# Altium schematic sheet 0020_Processor - POWER .SchDoc
size A2
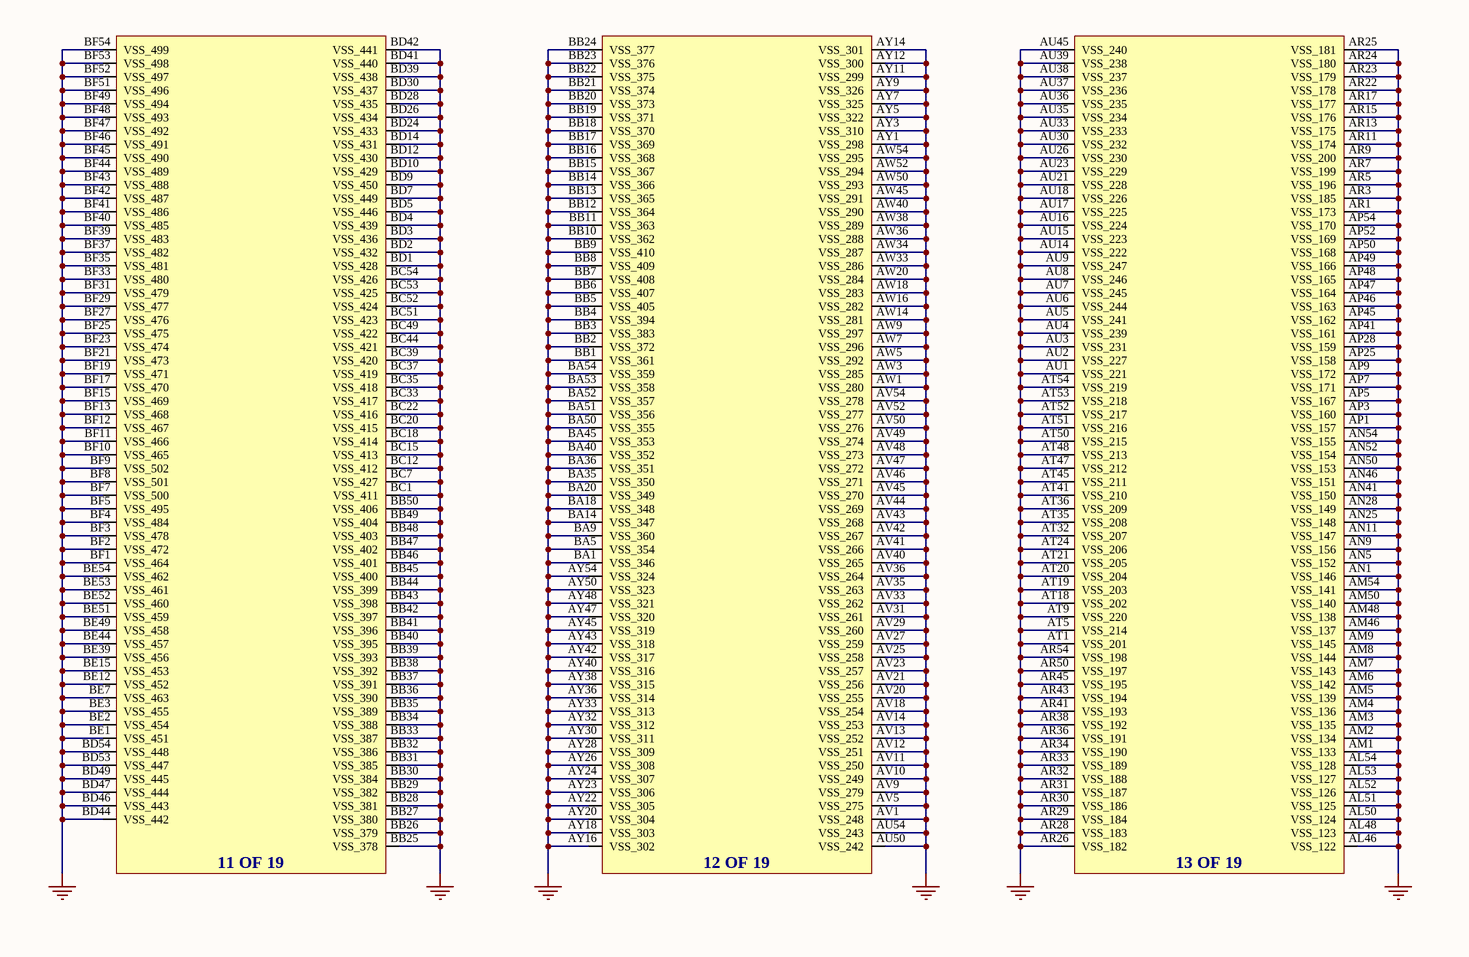
[diagram p0: 0020_Processor - POWER .SchDoc, left]
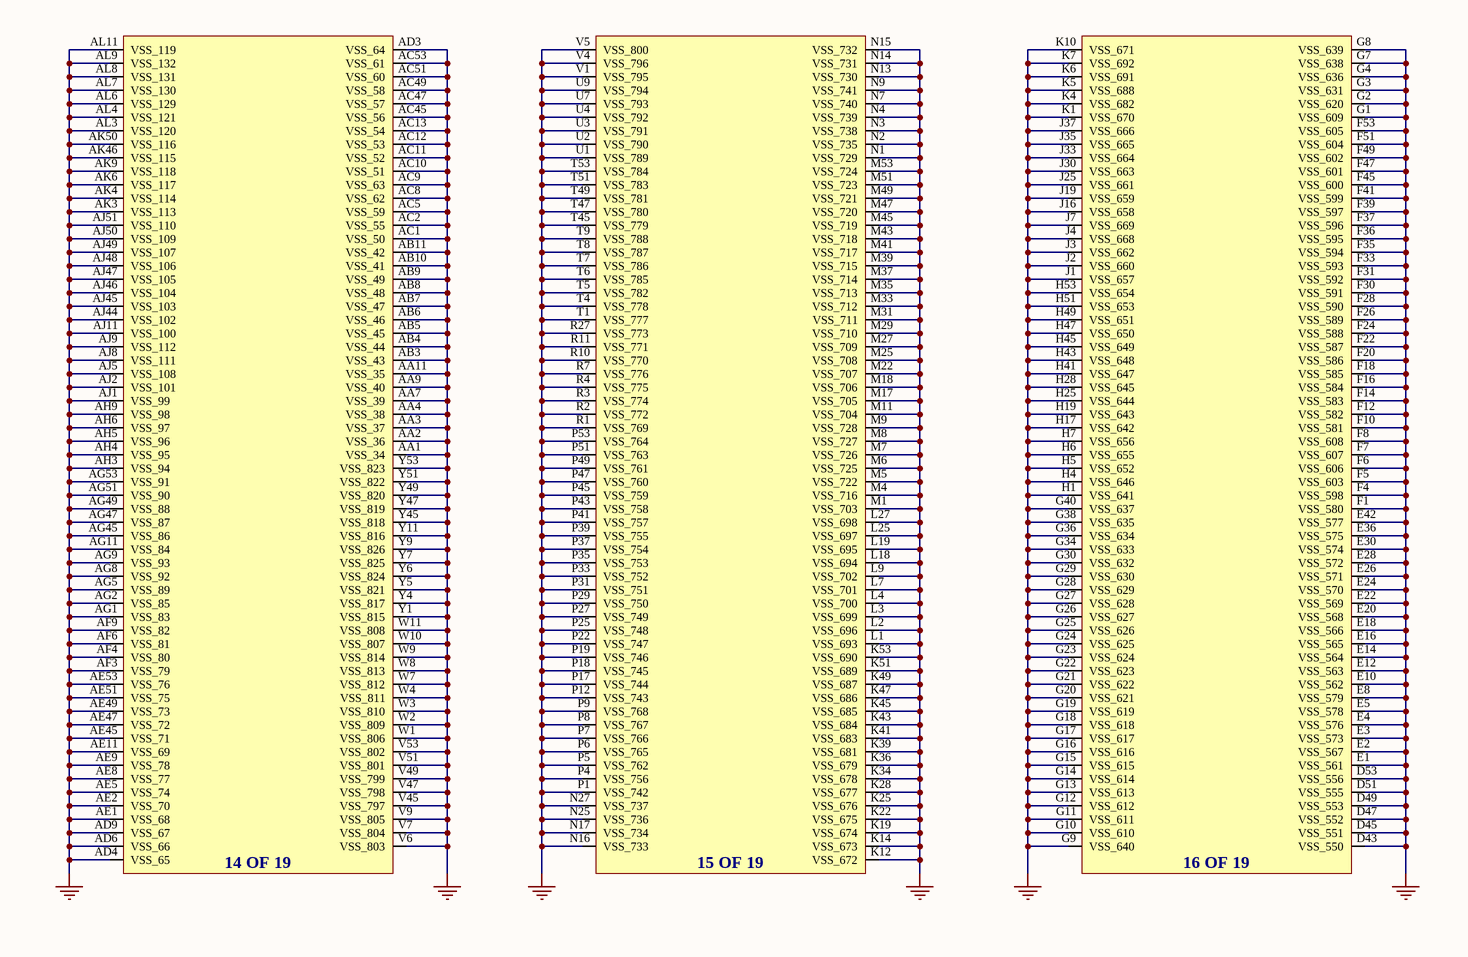
[diagram p1: 0020_Processor - POWER .SchDoc, right]

## Parts
U1401  C_RPL_HX_EXT  (value not drawn)  (parts K,L,M,N,O,P of 19)

## Nets
GND: U1401.AA1(VSS_34) U1401.AA2(VSS_36) U1401.AA3(VSS_37) U1401.AA4(VSS_38) U1401.AA7(VSS_39) U1401.AA9(VSS_40) U1401.AA11(VSS_35) U1401.AB3(VSS_43) U1401.AB4(VSS_44) U1401.AB5(VSS_45) U1401.AB6(VSS_46) U1401.AB7(VSS_47) U1401.AB8(VSS_48) U1401.AB9(VSS_49) U1401.AB10(VSS_41) U1401.AB11(VSS_42) U1401.AC1(VSS_50) U1401.AC2(VSS_55) U1401.AC5(VSS_59) U1401.AC8(VSS_62) U1401.AC9(VSS_63) U1401.AC10(VSS_51) U1401.AC11(VSS_52) U1401.AC12(VSS_53) U1401.AC13(VSS_54) U1401.AC45(VSS_56) U1401.AC47(VSS_57) U1401.AC49(VSS_58) U1401.AC51(VSS_60) U1401.AC53(VSS_61) U1401.AD3(VSS_64) U1401.AD4(VSS_65) U1401.AD6(VSS_66) U1401.AD9(VSS_67) U1401.AE1(VSS_68) U1401.AE2(VSS_70) U1401.AE5(VSS_74) U1401.AE8(VSS_77) U1401.AE9(VSS_78) U1401.AE11(VSS_69) U1401.AE45(VSS_71) U1401.AE47(VSS_72) U1401.AE49(VSS_73) U1401.AE51(VSS_75) U1401.AE53(VSS_76) U1401.AF3(VSS_79) U1401.AF4(VSS_80) U1401.AF6(VSS_81) U1401.AF9(VSS_82) U1401.AG1(VSS_83) U1401.AG2(VSS_85) U1401.AG5(VSS_89) U1401.AG8(VSS_92) U1401.AG9(VSS_93) U1401.AG11(VSS_84) U1401.AG45(VSS_86) U1401.AG47(VSS_87) U1401.AG49(VSS_88) U1401.AG51(VSS_90) U1401.AG53(VSS_91) U1401.AH3(VSS_94) U1401.AH4(VSS_95) U1401.AH5(VSS_96) U1401.AH6(VSS_97) U1401.AH9(VSS_98) U1401.AJ1(VSS_99) U1401.AJ2(VSS_101) U1401.AJ5(VSS_108) U1401.AJ8(VSS_111) U1401.AJ9(VSS_112) U1401.AJ11(VSS_100) U1401.AJ44(VSS_102) U1401.AJ45(VSS_103) U1401.AJ46(VSS_104) U1401.AJ47(VSS_105) U1401.AJ48(VSS_106) U1401.AJ49(VSS_107) U1401.AJ50(VSS_109) U1401.AJ51(VSS_110) U1401.AK3(VSS_113) U1401.AK4(VSS_114) U1401.AK6(VSS_117) U1401.AK9(VSS_118) U1401.AK46(VSS_115) U1401.AK50(VSS_116) U1401.AL3(VSS_120) U1401.AL4(VSS_121) U1401.AL6(VSS_129) U1401.AL7(VSS_130) U1401.AL8(VSS_131) U1401.AL9(VSS_132) U1401.AL11(VSS_119) U1401.AL46(VSS_122) U1401.AL48(VSS_123) U1401.AL50(VSS_124) U1401.AL51(VSS_125) U1401.AL52(VSS_126) U1401.AL53(VSS_127) U1401.AL54(VSS_128) U1401.AM1(VSS_133) U1401.AM2(VSS_134) U1401.AM3(VSS_135) U1401.AM4(VSS_136) U1401.AM5(VSS_139) U1401.AM6(VSS_142) U1401.AM7(VSS_143) U1401.AM8(VSS_144) U1401.AM9(VSS_145) U1401.AM46(VSS_137) U1401.AM48(VSS_138) U1401.AM50(VSS_140) U1401.AM54(VSS_141) U1401.AN1(VSS_146) U1401.AN5(VSS_152) U1401.AN9(VSS_156) U1401.AN11(VSS_147) U1401.AN25(VSS_148) U1401.AN28(VSS_149) U1401.AN41(VSS_150) U1401.AN46(VSS_151) U1401.AN50(VSS_153) U1401.AN52(VSS_154) U1401.AN54(VSS_155) U1401.AP1(VSS_157) U1401.AP3(VSS_160) U1401.AP5(VSS_167) U1401.AP7(VSS_171) U1401.AP9(VSS_172) U1401.AP25(VSS_158) U1401.AP28(VSS_159) U1401.AP41(VSS_161) U1401.AP45(VSS_162) U1401.AP46(VSS_163) U1401.AP47(VSS_164) U1401.AP48(VSS_165) U1401.AP49(VSS_166) U1401.AP50(VSS_168) U1401.AP52(VSS_169) U1401.AP54(VSS_170) U1401.AR1(VSS_173) U1401.AR3(VSS_185) U1401.AR5(VSS_196) U1401.AR7(VSS_199) U1401.AR9(VSS_200) U1401.AR11(VSS_174) U1401.AR13(VSS_175) U1401.AR15(VSS_176) U1401.AR17(VSS_177) U1401.AR22(VSS_178) U1401.AR23(VSS_179) U1401.AR24(VSS_180) U1401.AR25(VSS_181) U1401.AR26(VSS_182) U1401.AR28(VSS_183) U1401.AR29(VSS_184) U1401.AR30(VSS_186) U1401.AR31(VSS_187) U1401.AR32(VSS_188) U1401.AR33(VSS_189) U1401.AR34(VSS_190) U1401.AR36(VSS_191) U1401.AR38(VSS_192) U1401.AR41(VSS_193) U1401.AR43(VSS_194) U1401.AR45(VSS_195) U1401.AR50(VSS_197) U1401.AR54(VSS_198) U1401.AT1(VSS_201) U1401.AT5(VSS_214) U1401.AT9(VSS_220) U1401.AT18(VSS_202) U1401.AT19(VSS_203) U1401.AT20(VSS_204) U1401.AT21(VSS_205) U1401.AT24(VSS_206) U1401.AT32(VSS_207) U1401.AT35(VSS_208) U1401.AT36(VSS_209) U1401.AT41(VSS_210) U1401.AT45(VSS_211) U1401.AT47(VSS_212) U1401.AT48(VSS_213) U1401.AT50(VSS_215) U1401.AT51(VSS_216) U1401.AT52(VSS_217) U1401.AT53(VSS_218) U1401.AT54(VSS_219) U1401.AU1(VSS_221) U1401.AU2(VSS_227) U1401.AU3(VSS_231) U1401.AU4(VSS_239) U1401.AU5(VSS_241) U1401.AU6(VSS_244) U1401.AU7(VSS_245) U1401.AU8(VSS_246) U1401.AU9(VSS_247) U1401.AU14(VSS_222) U1401.AU15(VSS_223) U1401.AU16(VSS_224) U1401.AU17(VSS_225) U1401.AU18(VSS_226) U1401.AU21(VSS_228) U1401.AU23(VSS_229) U1401.AU26(VSS_230) U1401.AU30(VSS_232) U1401.AU33(VSS_233) U1401.AU35(VSS_234) U1401.AU36(VSS_235) U1401.AU37(VSS_236) U1401.AU38(VSS_237) U1401.AU39(VSS_238) U1401.AU45(VSS_240) U1401.AU50(VSS_242) U1401.AU54(VSS_243) U1401.AV1(VSS_248) U1401.AV5(VSS_275) U1401.AV9(VSS_279) U1401.AV10(VSS_249) U1401.AV11(VSS_250) U1401.AV12(VSS_251) U1401.AV13(VSS_252) U1401.AV14(VSS_253) U1401.AV18(VSS_254) U1401.AV20(VSS_255) U1401.AV21(VSS_256) U1401.AV23(VSS_257) U1401.AV25(VSS_258) U1401.AV27(VSS_259) U1401.AV29(VSS_260) U1401.AV31(VSS_261) U1401.AV33(VSS_262) U1401.AV35(VSS_263) U1401.AV36(VSS_264) U1401.AV40(VSS_265) U1401.AV41(VSS_266) U1401.AV42(VSS_267) U1401.AV43(VSS_268) U1401.AV44(VSS_269) U1401.AV45(VSS_270) U1401.AV46(VSS_271) U1401.AV47(VSS_272) U1401.AV48(VSS_273) U1401.AV49(VSS_274) U1401.AV50(VSS_276) U1401.AV52(VSS_277) U1401.AV54(VSS_278) U1401.AW1(VSS_280) U1401.AW3(VSS_285) U1401.AW5(VSS_292) U1401.AW7(VSS_296) U1401.AW9(VSS_297) U1401.AW14(VSS_281) U1401.AW16(VSS_282) U1401.AW18(VSS_283) U1401.AW20(VSS_284) U1401.AW33(VSS_286) U1401.AW34(VSS_287) U1401.AW36(VSS_288) U1401.AW38(VSS_289) U1401.AW40(VSS_290) U1401.AW45(VSS_291) U1401.AW50(VSS_293) U1401.AW52(VSS_294) U1401.AW54(VSS_295) U1401.AY1(VSS_298) U1401.AY3(VSS_310) U1401.AY5(VSS_322) U1401.AY7(VSS_325) U1401.AY9(VSS_326) U1401.AY11(VSS_299) U1401.AY12(VSS_300) U1401.AY14(VSS_301) U1401.AY16(VSS_302) U1401.AY18(VSS_303) U1401.AY20(VSS_304) U1401.AY22(VSS_305) U1401.AY23(VSS_306) U1401.AY24(VSS_307) U1401.AY26(VSS_308) U1401.AY28(VSS_309) U1401.AY30(VSS_311) U1401.AY32(VSS_312) U1401.AY33(VSS_313) U1401.AY36(VSS_314) U1401.AY38(VSS_315) U1401.AY40(VSS_316) U1401.AY42(VSS_317) U1401.AY43(VSS_318) U1401.AY45(VSS_319) U1401.AY47(VSS_320) U1401.AY48(VSS_321) U1401.AY50(VSS_323) U1401.AY54(VSS_324) U1401.BA1(VSS_346) U1401.BA5(VSS_354) U1401.BA9(VSS_360) U1401.BA14(VSS_347) U1401.BA18(VSS_348) U1401.BA20(VSS_349) U1401.BA35(VSS_350) U1401.BA36(VSS_351) U1401.BA40(VSS_352) U1401.BA45(VSS_353) U1401.BA50(VSS_355) U1401.BA51(VSS_356) U1401.BA52(VSS_357) U1401.BA53(VSS_358) U1401.BA54(VSS_359) U1401.BB1(VSS_361) U1401.BB2(VSS_372) U1401.BB3(VSS_383) U1401.BB4(VSS_394) U1401.BB5(VSS_405) U1401.BB6(VSS_407) U1401.BB7(VSS_408) U1401.BB8(VSS_409) U1401.BB9(VSS_410) U1401.BB10(VSS_362) U1401.BB11(VSS_363) U1401.BB12(VSS_364) U1401.BB13(VSS_365) U1401.BB14(VSS_366) U1401.BB15(VSS_367) U1401.BB16(VSS_368) U1401.BB17(VSS_369) U1401.BB18(VSS_370) U1401.BB19(VSS_371) U1401.BB20(VSS_373) U1401.BB21(VSS_374) U1401.BB22(VSS_375) U1401.BB23(VSS_376) U1401.BB24(VSS_377) U1401.BB25(VSS_378) U1401.BB26(VSS_379) U1401.BB27(VSS_380) U1401.BB28(VSS_381) U1401.BB29(VSS_382) U1401.BB30(VSS_384) U1401.BB31(VSS_385) U1401.BB32(VSS_386) U1401.BB33(VSS_387) U1401.BB34(VSS_388) U1401.BB35(VSS_389) U1401.BB36(VSS_390) U1401.BB37(VSS_391) U1401.BB38(VSS_392) U1401.BB39(VSS_393) U1401.BB40(VSS_395) U1401.BB41(VSS_396) U1401.BB42(VSS_397) U1401.BB43(VSS_398) U1401.BB44(VSS_399) U1401.BB45(VSS_400) U1401.BB46(VSS_401) U1401.BB47(VSS_402) U1401.BB48(VSS_403) U1401.BB49(VSS_404) U1401.BB50(VSS_406) U1401.BC1(VSS_411) U1401.BC7(VSS_427) U1401.BC12(VSS_412) U1401.BC15(VSS_413) U1401.BC18(VSS_414) U1401.BC20(VSS_415) U1401.BC22(VSS_416) U1401.BC33(VSS_417) U1401.BC35(VSS_418) U1401.BC37(VSS_419) U1401.BC39(VSS_420) U1401.BC44(VSS_421) U1401.BC49(VSS_422) U1401.BC51(VSS_423) U1401.BC52(VSS_424) U1401.BC53(VSS_425) U1401.BC54(VSS_426) U1401.BD1(VSS_428) U1401.BD2(VSS_432) U1401.BD3(VSS_436) U1401.BD4(VSS_439) U1401.BD5(VSS_446) U1401.BD7(VSS_449) U1401.BD9(VSS_450) U1401.BD10(VSS_429) U1401.BD12(VSS_430) U1401.BD14(VSS_431) U1401.BD24(VSS_433) U1401.BD26(VSS_434) U1401.BD28(VSS_435) U1401.BD30(VSS_437) U1401.BD39(VSS_438) U1401.BD41(VSS_440) U1401.BD42(VSS_441) U1401.BD44(VSS_442) U1401.BD46(VSS_443) U1401.BD47(VSS_444) U1401.BD49(VSS_445) U1401.BD53(VSS_447) U1401.BD54(VSS_448) U1401.BE1(VSS_451) U1401.BE2(VSS_454) U1401.BE3(VSS_455) U1401.BE7(VSS_463) U1401.BE12(VSS_452) U1401.BE15(VSS_453) U1401.BE39(VSS_456) U1401.BE44(VSS_457) U1401.BE49(VSS_458) U1401.BE51(VSS_459) U1401.BE52(VSS_460) U1401.BE53(VSS_461) U1401.BE54(VSS_462) U1401.BF1(VSS_464) U1401.BF2(VSS_472) U1401.BF3(VSS_478) U1401.BF4(VSS_484) U1401.BF5(VSS_495) U1401.BF7(VSS_500) U1401.BF8(VSS_501) U1401.BF9(VSS_502) U1401.BF10(VSS_465) U1401.BF11(VSS_466) U1401.BF12(VSS_467) U1401.BF13(VSS_468) U1401.BF15(VSS_469) U1401.BF17(VSS_470) U1401.BF19(VSS_471) U1401.BF21(VSS_473) U1401.BF23(VSS_474) U1401.BF25(VSS_475) U1401.BF27(VSS_476) U1401.BF29(VSS_477) U1401.BF31(VSS_479) U1401.BF33(VSS_480) U1401.BF35(VSS_481) U1401.BF37(VSS_482) U1401.BF39(VSS_483) U1401.BF40(VSS_485) U1401.BF41(VSS_486) U1401.BF42(VSS_487) U1401.BF43(VSS_488) U1401.BF44(VSS_489) U1401.BF45(VSS_490) U1401.BF46(VSS_491) U1401.BF47(VSS_492) U1401.BF48(VSS_493) U1401.BF49(VSS_494) U1401.BF51(VSS_496) U1401.BF52(VSS_497) U1401.BF53(VSS_498) U1401.BF54(VSS_499) U1401.D43(VSS_550) U1401.D45(VSS_551) U1401.D47(VSS_552) U1401.D49(VSS_553) U1401.D51(VSS_555) U1401.D53(VSS_556) U1401.E1(VSS_561) U1401.E2(VSS_567) U1401.E3(VSS_573) U1401.E4(VSS_576) U1401.E5(VSS_578) U1401.E8(VSS_579) U1401.E10(VSS_562) U1401.E12(VSS_563) U1401.E14(VSS_564) U1401.E16(VSS_565) U1401.E18(VSS_566) U1401.E20(VSS_568) U1401.E22(VSS_569) U1401.E24(VSS_570) U1401.E26(VSS_571) U1401.E28(VSS_572) U1401.E30(VSS_574) U1401.E36(VSS_575) U1401.E42(VSS_577) U1401.F1(VSS_580) U1401.F4(VSS_598) U1401.F5(VSS_603) U1401.F6(VSS_606) U1401.F7(VSS_607) U1401.F8(VSS_608) U1401.F10(VSS_581) U1401.F12(VSS_582) U1401.F14(VSS_583) U1401.F16(VSS_584) U1401.F18(VSS_585) U1401.F20(VSS_586) U1401.F22(VSS_587) U1401.F24(VSS_588) U1401.F26(VSS_589) U1401.F28(VSS_590) U1401.F30(VSS_591) U1401.F31(VSS_592) U1401.F33(VSS_593) U1401.F35(VSS_594) U1401.F36(VSS_595) U1401.F37(VSS_596) U1401.F39(VSS_597) U1401.F41(VSS_599) U1401.F45(VSS_600) U1401.F47(VSS_601) U1401.F49(VSS_602) U1401.F51(VSS_604) U1401.F53(VSS_605) U1401.G1(VSS_609) U1401.G2(VSS_620) U1401.G3(VSS_631) U1401.G4(VSS_636) U1401.G7(VSS_638) U1401.G8(VSS_639) U1401.G9(VSS_640) U1401.G10(VSS_610) U1401.G11(VSS_611) U1401.G12(VSS_612) U1401.G13(VSS_613) U1401.G14(VSS_614) U1401.G15(VSS_615) U1401.G16(VSS_616) U1401.G17(VSS_617) U1401.G18(VSS_618) U1401.G19(VSS_619) U1401.G20(VSS_621) U1401.G21(VSS_622) U1401.G22(VSS_623) U1401.G23(VSS_624) U1401.G24(VSS_625) U1401.G25(VSS_626) U1401.G26(VSS_627) U1401.G27(VSS_628) U1401.G28(VSS_629) U1401.G29(VSS_630) U1401.G30(VSS_632) U1401.G34(VSS_633) U1401.G36(VSS_634) U1401.G38(VSS_635) U1401.G40(VSS_637) U1401.H1(VSS_641) U1401.H4(VSS_646) U1401.H5(VSS_652) U1401.H6(VSS_655) U1401.H7(VSS_656) U1401.H17(VSS_642) U1401.H19(VSS_643) U1401.H25(VSS_644) U1401.H28(VSS_645) U1401.H41(VSS_647) U1401.H43(VSS_648) U1401.H45(VSS_649) U1401.H47(VSS_650) U1401.H49(VSS_651) U1401.H51(VSS_653) U1401.H53(VSS_654) U1401.J1(VSS_657) U1401.J2(VSS_660) U1401.J3(VSS_662) U1401.J4(VSS_668) U1401.J7(VSS_669) U1401.J16(VSS_658) U1401.J19(VSS_659) U1401.J25(VSS_661) U1401.J30(VSS_663) U1401.J33(VSS_664) U1401.J35(VSS_665) U1401.J37(VSS_666) U1401.K1(VSS_670) U1401.K4(VSS_682) U1401.K5(VSS_688) U1401.K6(VSS_691) U1401.K7(VSS_692) U1401.K10(VSS_671) U1401.K12(VSS_672) U1401.K14(VSS_673) U1401.K19(VSS_674) U1401.K22(VSS_675) U1401.K25(VSS_676) U1401.K28(VSS_677) U1401.K34(VSS_678) U1401.K36(VSS_679) U1401.K39(VSS_681) U1401.K41(VSS_683) U1401.K43(VSS_684) U1401.K45(VSS_685) U1401.K47(VSS_686) U1401.K49(VSS_687) U1401.K51(VSS_689) U1401.K53(VSS_690) U1401.L1(VSS_693) U1401.L2(VSS_696) U1401.L3(VSS_699) U1401.L4(VSS_700) U1401.L7(VSS_701) U1401.L9(VSS_702) U1401.L18(VSS_694) U1401.L19(VSS_695) U1401.L25(VSS_697) U1401.L27(VSS_698) U1401.M1(VSS_703) U1401.M4(VSS_716) U1401.M5(VSS_722) U1401.M6(VSS_725) U1401.M7(VSS_726) U1401.M8(VSS_727) U1401.M9(VSS_728) U1401.M11(VSS_704) U1401.M17(VSS_705) U1401.M18(VSS_706) U1401.M22(VSS_707) U1401.M25(VSS_708) U1401.M27(VSS_709) U1401.M29(VSS_710) U1401.M31(VSS_711) U1401.M33(VSS_712) U1401.M35(VSS_713) U1401.M37(VSS_714) U1401.M39(VSS_715) U1401.M41(VSS_717) U1401.M43(VSS_718) U1401.M45(VSS_719) U1401.M47(VSS_720) U1401.M49(VSS_721) U1401.M51(VSS_723) U1401.M53(VSS_724) U1401.N1(VSS_729) U1401.N2(VSS_735) U1401.N3(VSS_738) U1401.N4(VSS_739) U1401.N7(VSS_740) U1401.N9(VSS_741) U1401.N13(VSS_730) U1401.N14(VSS_731) U1401.N15(VSS_732) U1401.N16(VSS_733) U1401.N17(VSS_734) U1401.N25(VSS_736) U1401.N27(VSS_737) U1401.P1(VSS_742) U1401.P4(VSS_756) U1401.P5(VSS_762) U1401.P6(VSS_765) U1401.P7(VSS_766) U1401.P8(VSS_767) U1401.P9(VSS_768) U1401.P12(VSS_743) U1401.P17(VSS_744) U1401.P18(VSS_745) U1401.P19(VSS_746) U1401.P22(VSS_747) U1401.P25(VSS_748) U1401.P27(VSS_749) U1401.P29(VSS_750) U1401.P31(VSS_751) U1401.P33(VSS_752) U1401.P35(VSS_753) U1401.P37(VSS_754) U1401.P39(VSS_755) U1401.P41(VSS_757) U1401.P43(VSS_758) U1401.P45(VSS_759) U1401.P47(VSS_760) U1401.P49(VSS_761) U1401.P51(VSS_763) U1401.P53(VSS_764) U1401.R1(VSS_769) U1401.R2(VSS_772) U1401.R3(VSS_774) U1401.R4(VSS_775) U1401.R7(VSS_776) U1401.R10(VSS_770) U1401.R11(VSS_771) U1401.R27(VSS_773) U1401.T1(VSS_777) U1401.T4(VSS_778) U1401.T5(VSS_782) U1401.T6(VSS_785) U1401.T7(VSS_786) U1401.T8(VSS_787) U1401.T9(VSS_788) U1401.T45(VSS_779) U1401.T47(VSS_780) U1401.T49(VSS_781) U1401.T51(VSS_783) U1401.T53(VSS_784) U1401.U1(VSS_789) U1401.U2(VSS_790) U1401.U3(VSS_791) U1401.U4(VSS_792) U1401.U7(VSS_793) U1401.U9(VSS_794) U1401.V1(VSS_795) U1401.V4(VSS_796) U1401.V5(VSS_800) U1401.V6(VSS_803) U1401.V7(VSS_804) U1401.V9(VSS_805) U1401.V45(VSS_797) U1401.V47(VSS_798) U1401.V49(VSS_799) U1401.V51(VSS_801) U1401.V53(VSS_802) U1401.W1(VSS_806) U1401.W2(VSS_809) U1401.W3(VSS_810) U1401.W4(VSS_811) U1401.W7(VSS_812) U1401.W8(VSS_813) U1401.W9(VSS_814) U1401.W10(VSS_807) U1401.W11(VSS_808) U1401.Y1(VSS_815) U1401.Y4(VSS_817) U1401.Y5(VSS_821) U1401.Y6(VSS_824) U1401.Y7(VSS_825) U1401.Y9(VSS_826) U1401.Y11(VSS_816) U1401.Y45(VSS_818) U1401.Y47(VSS_819) U1401.Y49(VSS_820) U1401.Y51(VSS_822) U1401.Y53(VSS_823)

## Notes on the sheet
- (in symbol C_RPL_HX_EXT, part K) 11 OF 19
- (in symbol C_RPL_HX_EXT, part L) 12 OF 19
- (in symbol C_RPL_HX_EXT, part M) 13 OF 19
- (in symbol C_RPL_HX_EXT, part N) 14 OF 19
- (in symbol C_RPL_HX_EXT, part O) 15 OF 19
- (in symbol C_RPL_HX_EXT, part P) 16 OF 19